# EasyEDA Pro project core_board.eprj

# Schematic SCH1

## Sheets
1 interface: Create Date: 2023-12-02; Page Name: interface; Project Name: core_board(8)(2); Schematic Name: SCH1; Update Date: 2023-12-17; Drawed: luq; Page Size: A4; Version: V1.0
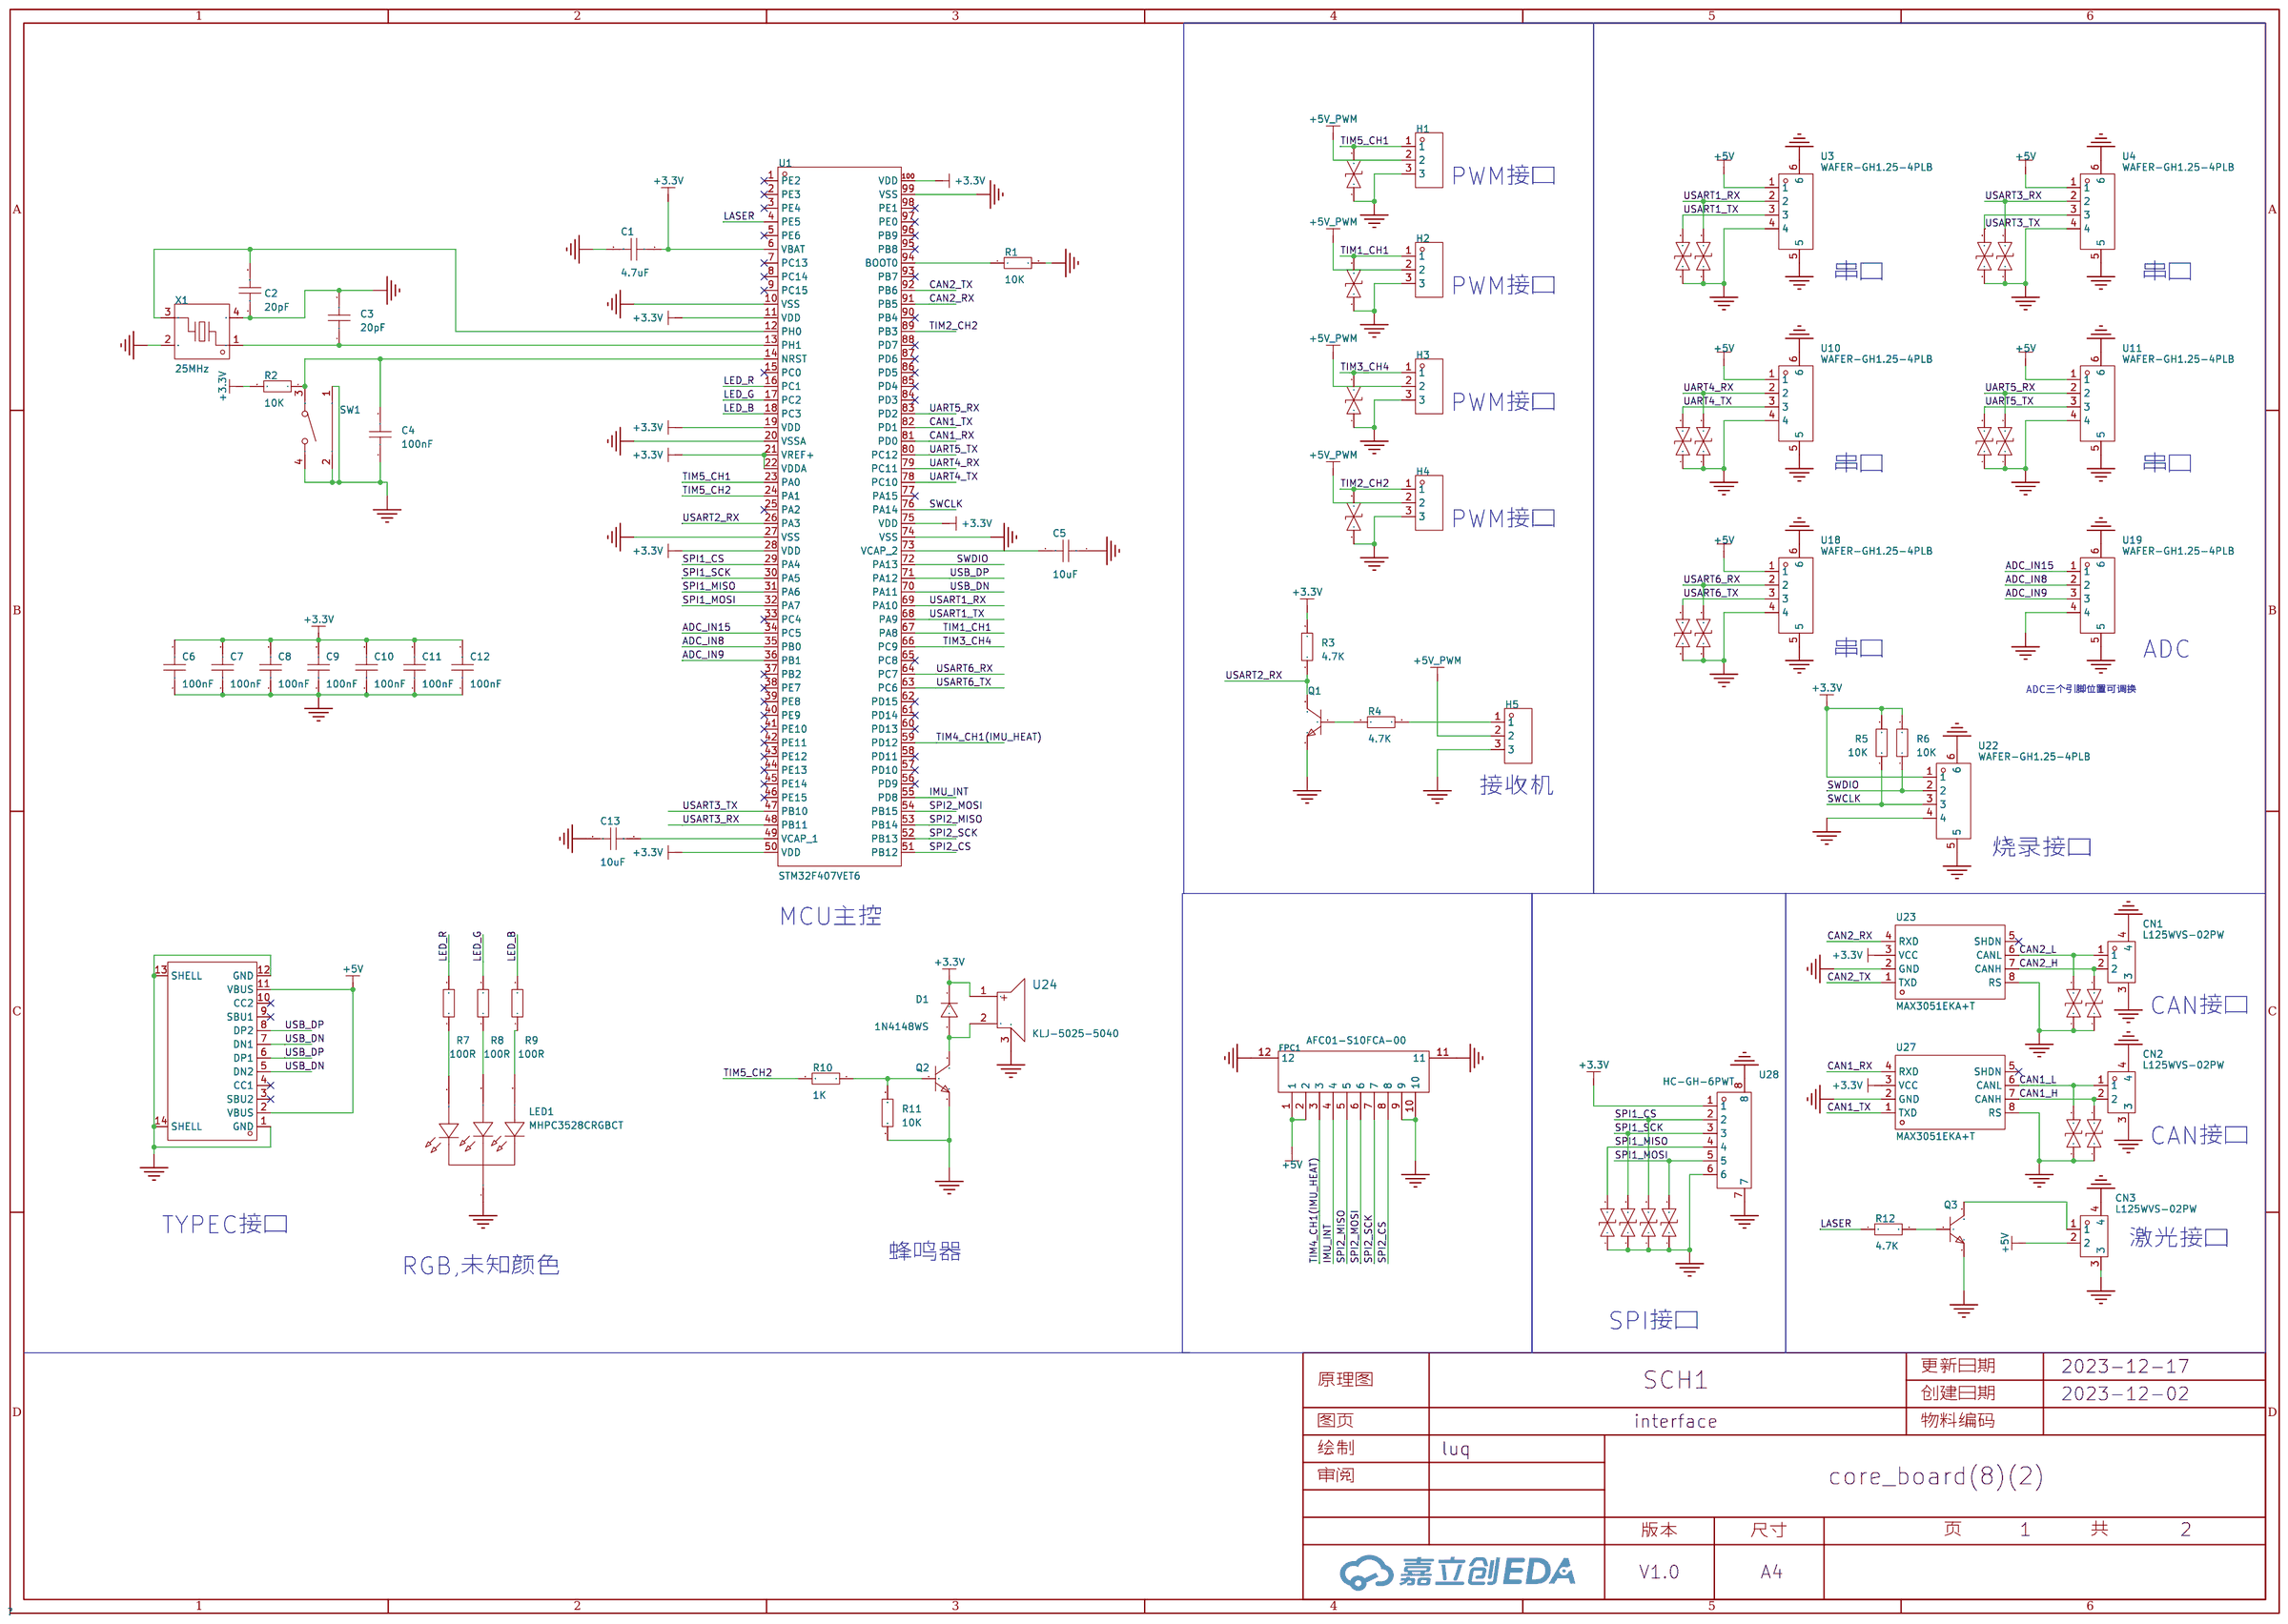
[diagram p0: interface]
2 power: Create Date: 2023-12-09; Page Name: power; Update Date: 2023-12-21
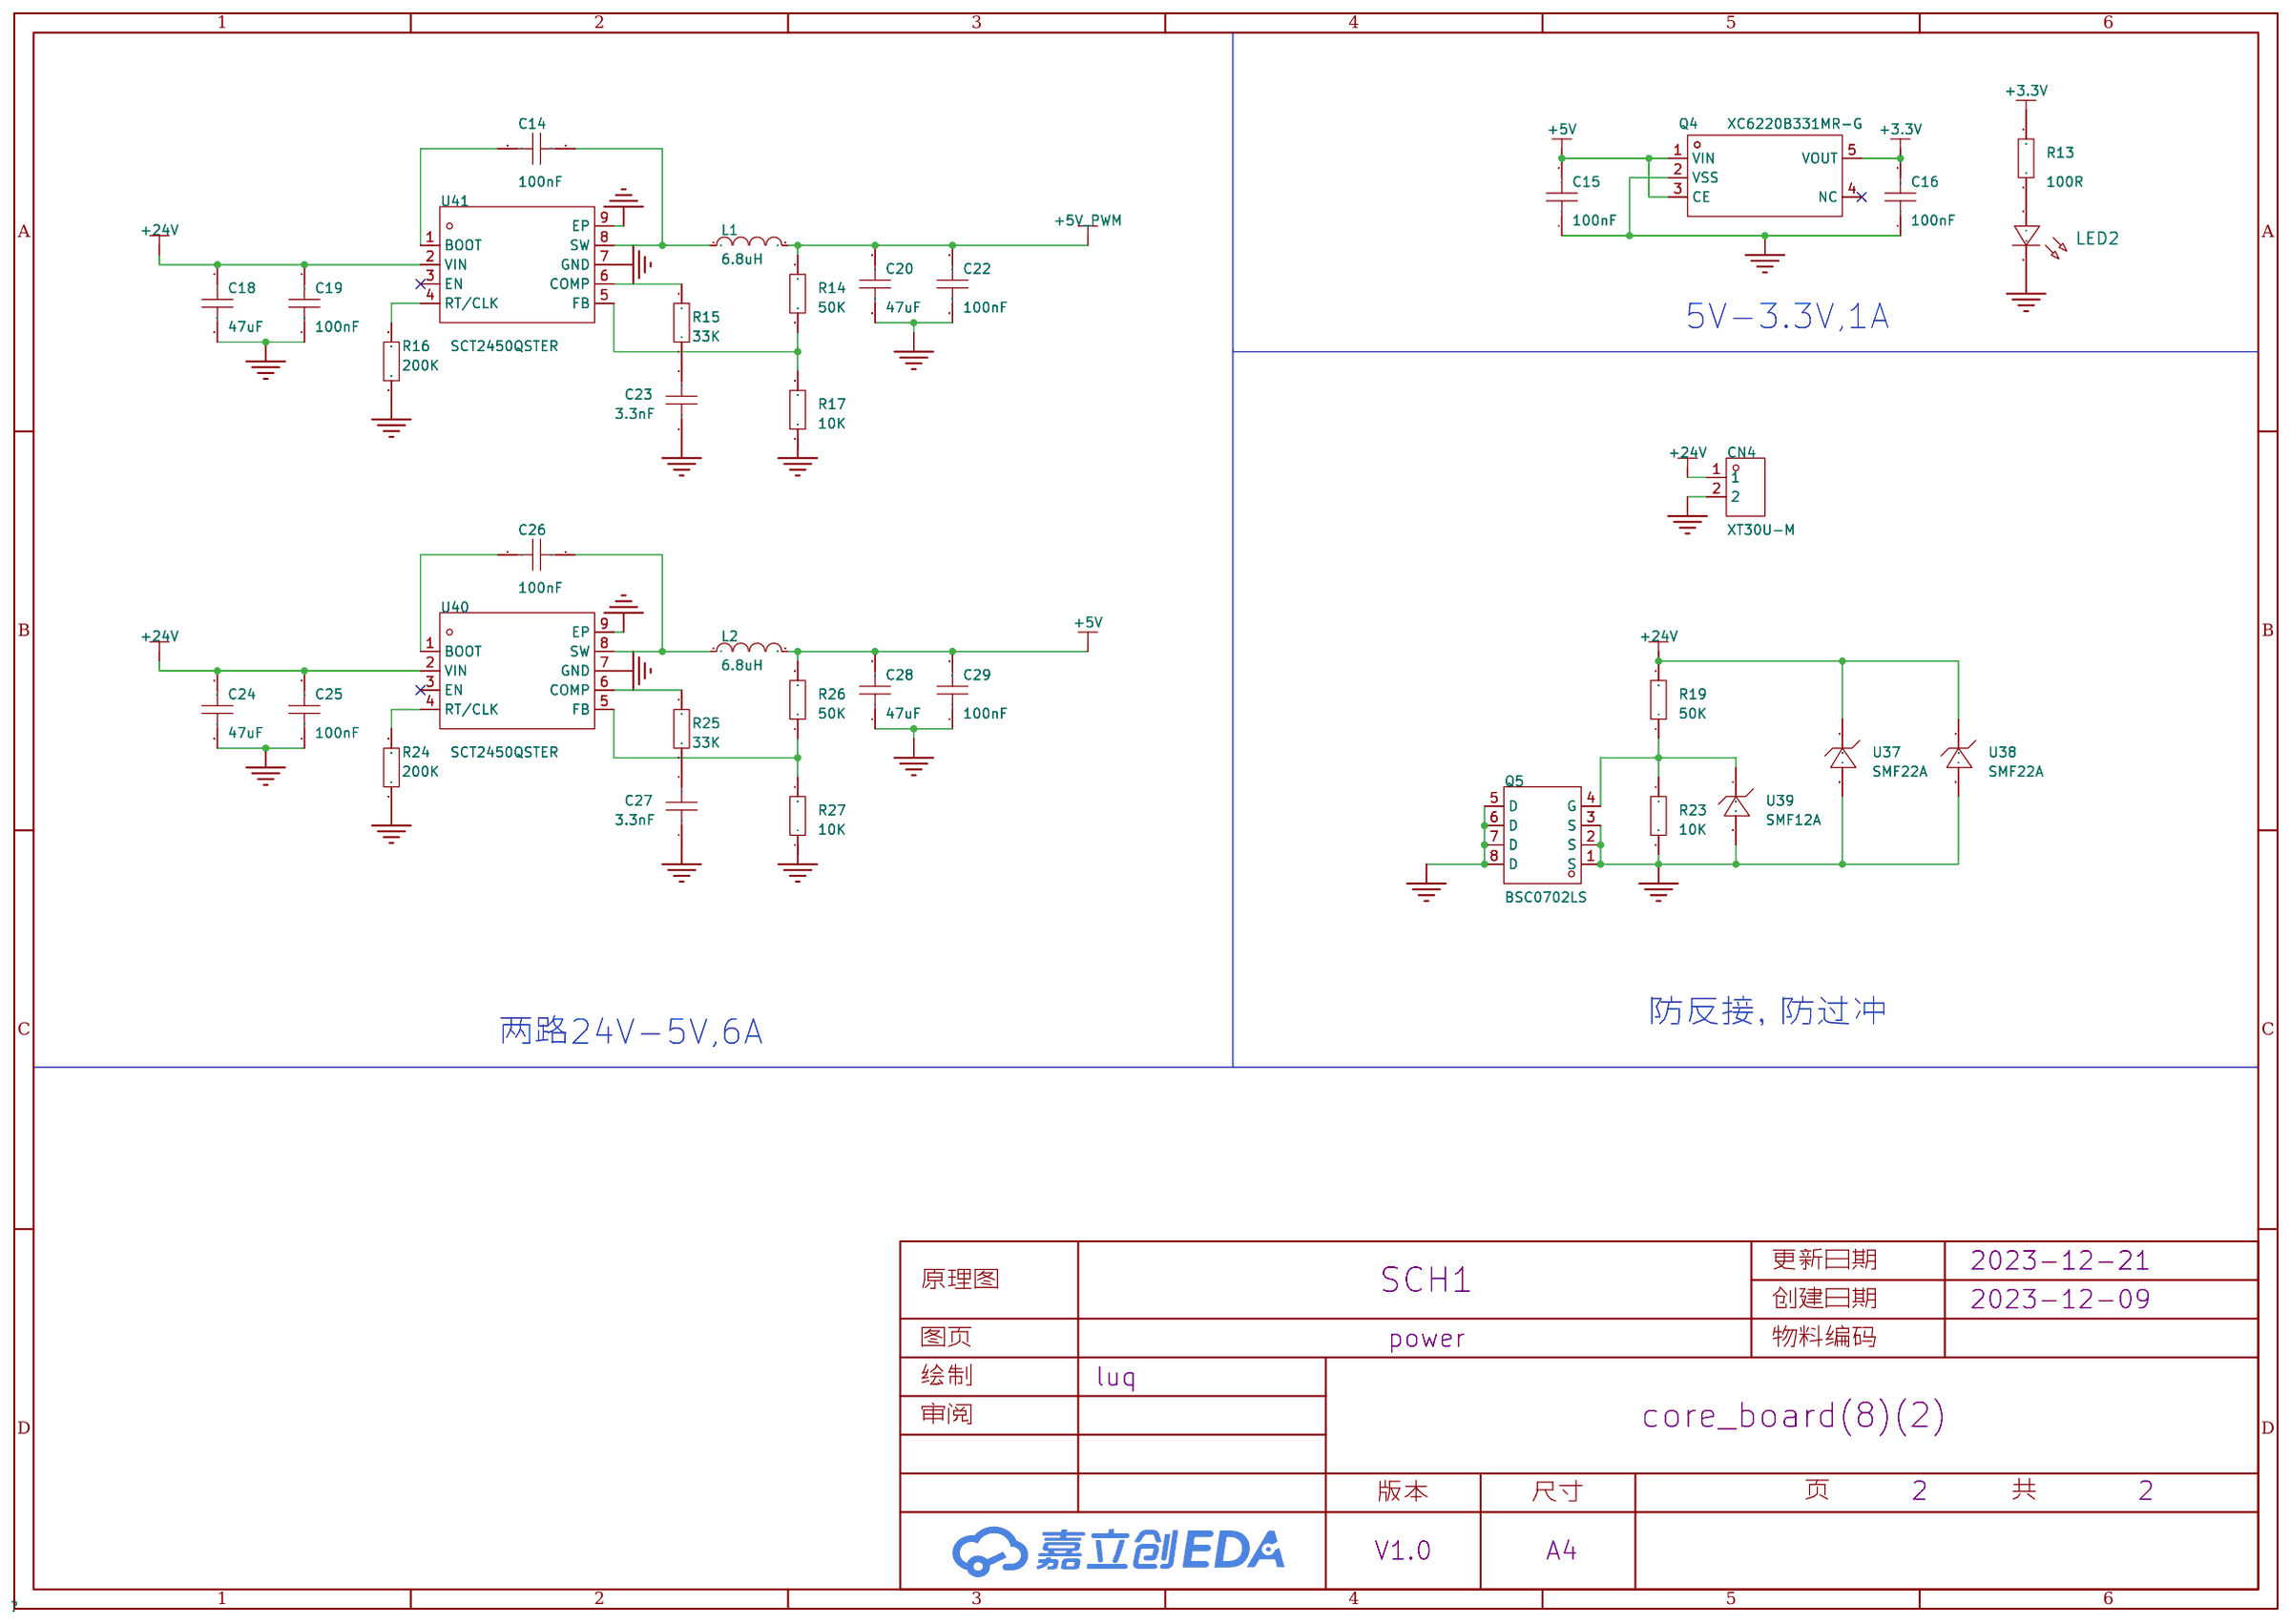
[diagram p1: power]

## Parts
sheet interface
C1  4.7uF  [C0402]
C2  20pF  [C0402]
C3  20pF  [C0402]
C4  100nF  [C0402]
C5  10uF  [C0402]
C6  100nF  [C0402]
C7  100nF  [C0402]
C8  100nF  [C0402]
C9  100nF  [C0402]
C10  100nF  [C0402]
C11  100nF  [C0402]
C12  100nF  [C0402]
C13  10uF  [C0402]
CN1  L125WVS-02PW  [CONN-SMD_2P-P1.25_DELON_L125WVS-02PW]
CN2  L125WVS-02PW  [CONN-SMD_2P-P1.25_DELON_L125WVS-02PW]
CN3  L125WVS-02PW  [CONN-SMD_2P-P1.25_DELON_L125WVS-02PW]
D1  1N4148WS  [SOD-323_L1.8-W1.3-LS2.5-RD]
FPC1  AFC01-S10FCA-00  [FPC-SMD_P0.5-10P_FGS-XJ-H2.0]
H1  -  [HDR-TH_3P-P2.54-V-M]
H2  -  [HDR-TH_3P-P2.54-V-M]
H3  -  [HDR-TH_3P-P2.54-V-M]
H4  -  [HDR-TH_3P-P2.54-V-M]
H5  -  [HDR-TH_3P-P2.54-V-M]
LED1  MHPC3528CRGBCT  [LED-SMD_4P-L3.2-W2.8-BL]
Q1  -  [S8050_SOT-23]
Q2  -  [S8050_SOT-23]
Q3  -  [S8050_SOT-23]
R1  10K  [R0402]
R2  10K  [R0402]
R3  4.7K  [R0603]
R4  4.7K  [R0603]
R5  10K  [R0603]
R6  10K  [R0603]
R7  100R  [R0402]
R8  100R  [R0402]
R9  100R  [R0402]
R10  1K  [R0603]
R11  10K  [R0603]
R12  4.7K  [R0603]
SW1  TS24CA  [SW-SMD_TS24CA]
U1  STM32F407VET6  [LQFP-100_L14.0-W14.0-P0.50-LS16.0-BL]
U2  PESD5V0F1BL  [SOD-882_L1.0-W0.6-BI]
U3  WAFER-GH1.25-4PLB  [CONN-SMD_4P-P1.25_XUNPU_WAFER-GH1.25-4PLB]
U4  WAFER-GH1.25-4PLB  [CONN-SMD_4P-P1.25_XUNPU_WAFER-GH1.25-4PLB]
U5  PESD5V0F1BL  [SOD-882_L1.0-W0.6-BI]
U6  PESD5V0F1BL  [SOD-882_L1.0-W0.6-BI]
U7  PESD5V0F1BL  [SOD-882_L1.0-W0.6-BI]
U8  PESD5V0F1BL  [SOD-882_L1.0-W0.6-BI]
U9  PESD5V0F1BL  [SOD-882_L1.0-W0.6-BI]
U10  WAFER-GH1.25-4PLB  [CONN-SMD_4P-P1.25_XUNPU_WAFER-GH1.25-4PLB]
U11  WAFER-GH1.25-4PLB  [CONN-SMD_4P-P1.25_XUNPU_WAFER-GH1.25-4PLB]
U12  PESD5V0F1BL  [SOD-882_L1.0-W0.6-BI]
U13  PESD5V0F1BL  [SOD-882_L1.0-W0.6-BI]
U14  PESD5V0F1BL  [SOD-882_L1.0-W0.6-BI]
U15  PESD5V0F1BL  [SOD-882_L1.0-W0.6-BI]
U16  PESD5V0F1BL  [SOD-882_L1.0-W0.6-BI]
U17  PESD5V0F1BL  [SOD-882_L1.0-W0.6-BI]
U18  WAFER-GH1.25-4PLB  [CONN-SMD_4P-P1.25_XUNPU_WAFER-GH1.25-4PLB]
U19  WAFER-GH1.25-4PLB  [CONN-SMD_4P-P1.25_XUNPU_WAFER-GH1.25-4PLB]
U20  PESD5V0F1BL  [SOD-882_L1.0-W0.6-BI]
U21  PESD5V0F1BL  [SOD-882_L1.0-W0.6-BI]
U22  WAFER-GH1.25-4PLB  [CONN-SMD_4P-P1.25_XUNPU_WAFER-GH1.25-4PLB]
U23  MAX3051EKA+T  [SOT-23-8_L3.0-W1.7-P0.65-LS2.8-TL]
U24  KLJ-5025-5040  [BUZ-SMD_3P-L5.0-W5.0-BL]
U25  PESD5V0F1BL  [SOD-882_L1.0-W0.6-BI]
U26  PESD5V0F1BL  [SOD-882_L1.0-W0.6-BI]
U27  MAX3051EKA+T  [SOT-23-8_L3.0-W1.7-P0.65-LS2.8-TL]
U28  HC-GH-6PWT  [CONN-SMD_6P-P1.25_HCTL_HC-GH-6PWT]
U29  PESD5V0F1BL  [SOD-882_L1.0-W0.6-BI]
U30  PESD5V0F1BL  [SOD-882_L1.0-W0.6-BI]
U31  PESD5V0F1BL  [SOD-882_L1.0-W0.6-BI]
U32  PESD5V0F1BL  [SOD-882_L1.0-W0.6-BI]
U33  PESD5V0F1BL  [SOD-882_L1.0-W0.6-BI]
U34  PESD5V0F1BL  [SOD-882_L1.0-W0.6-BI]
USB1  TYPE-C 16PIN 2MD(073)  [USB-C-SMD_TYPE-C-6PIN-2MD-073]
X1  25MHz  [CRYSTAL-SMD_4P-L3.2-W2.5-BL]
sheet power
C14  100nF  [C0603]
C15  100nF  [C0402]
C16  100nF  [C0402]
C18  47uF  [C1206]
C19  100nF  [C0603]
C20  47uF  [C1206]
C22  100nF  [C0603]
C23  3.3nF  [C0603]
C24  47uF  [C1206]
C25  100nF  [C0603]
C26  100nF  [C0603]
C27  3.3nF  [C0603]
C28  47uF  [C1206]
C29  100nF  [C0603]
CN4  XT30U-M  [CONN-TH_XT30U-M]
L1  6.8uH  [IND-SMD_L7.0-W6.6]
L2  6.8uH  [IND-SMD_L7.0-W6.6]
LED2  -  [LED_0603]
Q4  XC6220B331MR-G  [SOT-25_L3.0-W1.6-P0.95-LS2.8-TL]
Q5  BSC0702LS  [PG-TDSON-8_L5.0-W6.0-P1.27-BL-EP]
R13  100R  [R0402]
R14  50K  [R0603]
R15  33K  [R0603]
R16  200K  [R0603]
R17  10K  [R0603]
R19  50K  [R0402]
R23  10K  [R0402]
R24  200K  [R0603]
R25  33K  [R0603]
R26  50K  [R0603]
R27  10K  [R0603]
U37  SMF22A  [SOD-123FL_L2.8-W1.9-LS3.7-RD]
U38  SMF22A  [SOD-123FL_L2.8-W1.9-LS3.7-RD]
U39  SMF12A  [SOD-123FL_L2.7-W1.8-LS3.7-RD]
U40  SCT2450QSTER  [ESOP-8_L4.9-W3.9-P1.27-LS6.0-BL-EP]
U41  SCT2450QSTER  [ESOP-8_L4.9-W3.9-P1.27-LS6.0-BL-EP]

## Library data of the parts
C1-C16 C23 C26 C27 = CAP_0402: Supplier Footprint: 0402
CN1-CN3 = L125WVS-02PW: 插针结构:1x2P;间距:1.25mm;公母:公;安装方式:卧贴;排数:1;每排PIN数:2;额定电流:1A;工作温度范围:-40℃~+110℃;; LCSC Part Name: 1x2P 间距:1.25mm 卧贴 GH1.25间距卧式贴片 2P 连接器; Supplier Part: C2998790; Manufacturer: DEALON(德艺隆); Supplier Footprint: SMD,P=1.25mm; JLCPCB Part Class: 扩展库; Datasheet: https://atta.szlcsc.com/upload/public/pdf/source/20220425/50B09E6409C3A2782C6D65104D18E34A.pdf; Supplier: LCSC; Pins Structure: 1x2P; Pitch: 1.25mm; Gender: 公; Mounting Style: 卧贴; Number of Rows: 1; Number of PINs Per Row: 2; Current Rating (Max): 1A; Operating Temperature Range: -40℃~+110℃
D1 = 1N4148WS_C2128: 二极管配置:独立式;正向压降(Vf):1.25V@150mA;直流反向耐压(Vr):100V;平均整流电流(Io):150mA;功率:200mW;反向恢复时间(trr):4ns;; LCSC Part Name: 电压:100V 电流:150mA; Supplier Part: C2128; Manufacturer: CJ(江苏长电/长晶); Supplier Footprint: SOD-323; JLCPCB Part Class: Basic Part; Datasheet: https://atta.szlcsc.com/upload/public/pdf/source/20140809/1457707208178.pdf; Supplier: LCSC; Diode Configuration: 独立式; Forward Voltage (Vf@If): 1.25V@150mA; Reverse Voltage (Vr): 100V; Average Rectified Current (Io): 150mA; Power Dissipation: 200mW; Reverse Leakage Current: 1uA@75V; Reverse Recovery Time (trr): 4ns
FPC1 = AFC01-S10FCA-00: 间距:0.5mm;触点数量:10P;锁定特性:翻盖式;安装类型:卧贴;触点类型:下接;; LCSC Part Name: 0.5mm P数:10P 翻盖式 下接; Supplier Part: C262659; Manufacturer: JS(钜硕电子); Supplier Footprint: SMD,P=0.5mm; JLCPCB Part Class: 扩展库; Datasheet: https://atta.szlcsc.com/upload/public/pdf/source/20190816/C413942_2A72D1AC756EAE17EEDF756A339D4500.pdf; Supplier: LCSC; Pitch: 0.5mm; Number of Contacts: 10P; Locking Feature: 翻盖式; Mounting Type: 卧贴; Contact Type: 下接; Height Above Board: 2mm; FFC, FCB Thickness: 0.3mm
H1-H5 = HDR-M_2.54_1x3P: Supplier Part: C2937625; Supplier Footprint: 插件
LED1 = MHPC3528CRGBCT: 发光颜色:RGB三色;二极管配置:共阴极;功率:100mW；60mW；110mW;透镜颜色:无色透明透镜;主波长:621nm；520nm；465nm;色温:-;发光角度:120°;安装方式:正贴;工作温度:-40℃~+85℃;; LCSC Part Name: RGB三色 正贴; Supplier Part: C2962096; Manufacturer: MEIHUA(美华); Supplier Footprint: SMD3528; JLCPCB Part Class: 扩展库; Datasheet: https://atta.szlcsc.com/upload/public/pdf/source/20220214/73087548F13E6E0DCDC909BC417D1CBB.pdf; Supplier: LCSC; Emitted Color: RGB三色; Diode Configuration: 共阴极; Forward Current: 20mA; Power Dissipation: 100mW；60mW；110mW; Lens Color: 无色透明透镜; Dominant Wavelength: 621nm；520nm；465nm; Peak Wavelength: 460nm；630nm；515nm; Viewing Angle: 120°; Mounting Sytle: 正贴; Operating Temperature: -40℃~+85℃
Q1-Q3 = S8050_SOT_NPN: Supplier Footprint: SOT-23
R1 R2 R7-R9 R13-R17 R19 R23-R27 = Res_0402: Supplier Footprint: 0402
R3-R6 R10-R12 = Res_0603: Supplier Footprint: 0603
SW1 = TS24CA: 触点电流:50mA;额定电压(DC):12V;电路结构:单刀单掷;安装方式:卧贴;带灯:-;机械寿命:-;; LCSC Part Name: 4.55*1.8*3.5mm 卧贴 轻触开关; Supplier Part: C393942; Manufacturer: SHOU HAN(首韩); Supplier Footprint: SMD; JLCPCB Part Class: 扩展库; Datasheet: https://atta.szlcsc.com/upload/public/pdf/source/20190521/C393942_591A9E318887EFA4274D34029981AD99.pdf; Supplier: LCSC; Contact Current: 50mA; Voltage Rating (DC): 12V; Circuit: 单刀单掷; Mounting Style: 卧贴; Actuator Style: 矩形按钮; Switch Length: 4.55mm; Switch Width: 1.8mm; Switch Height: 3.5mm
U1 = STM32F407VGT6: CPU内核:ARM Cortex-M4;CPU最大主频:168MHz;工作电压范围:1.8V~3.6V;程序存储容量:1MB;程序存储器类型:FLASH;RAM总容量:192KB;GPIO端口数量:82;; Supplier Part: C12345; Manufacturer: ST(意法半导体); Supplier Footprint: LQFP-100(14x14); JLCPCB Part Class: 扩展库; Datasheet: https://atta.szlcsc.com/upload/public/pdf/source/20140801/1457707197138.pdf; Supplier: LCSC; CPU Core: ARM Cortex-M4; CPU Maximum Speed: 168MHz; Operating Voltage Range: 1.8V~3.6V; Program Storage Size: 1MB; Program Memory Type: FLASH; RAM Size: 192KB; GPIO Ports Number: 82; ADC (Bit): 12bit; DAC (Bit): 12bit; Universal Serial Bus: 有; Peripheral/Function: DMA；LCD/LED驱动; Watchdog: 有; Infrared Data Association: 有; Low-Voltage Detect: 有; LCD Module: 有; Direct Memory Access: 有; Internal Oscillator: 有; Operating Temperature Range: -40℃~+85℃
U2 U5-U9 U12-U17 U20 U21 U25 U26 U29-U34 = PESD5V0F1BL_C3001950: Supplier Part: C3001950; Manufacturer: UMW(友台半导体); Supplier Footprint: SOD-882; JLCPCB Part Class: 扩展库; Datasheet: https://atta.szlcsc.com/upload/public/pdf/source/20220425/FF8C97AEF8D545165C1993D730ADA9C6.pdf; Supplier: LCSC
U3 U4 U10 U11 U18 U19 U22 = WAFER-GH1.25-4PLB: 插针结构:1x4P;间距:1.25mm;公母:公;安装方式:立贴;排数:1;每排PIN数:4;参考系列:GH;额定电流:1A;工作温度范围:-25℃~+85℃;; LCSC Part Name: 1x4P 间距:1.25mm 立贴 系列:GH 带扣; Supplier Part: C3029370; Manufacturer: XUNPU(讯普); Supplier Footprint: SMD,P=1.25mm; JLCPCB Part Class: 扩展库; Datasheet: https://atta.szlcsc.com/upload/public/pdf/source/20220527/44F824AAC8C2B617205E15955FF9C23D.pdf; Supplier: LCSC; Pins Structure: 1x4P; Pitch: 1.25mm; Gender: 公; Mounting Style: 立贴; Number of Rows: 1; Number of PINs Per Row: 4; Reference Series: GH; Current Rating (Max): 1A; Operating Temperature Range: -25℃~+85℃
U23 U27 = MAX3051EKA+T: 类型:收发器;数据速率:1Mbps;; LCSC Part Name: 1Mbps 3.14V~3.47V; Supplier Part: C112005; Manufacturer: ADI(亚德诺); Supplier Footprint: SOT-23-8; JLCPCB Part Class: 扩展库; Datasheet: https://atta.szlcsc.com/upload/public/pdf/source/20171014/C112005_15079752662991037925.pdf; Supplier: LCSC; Type: 收发器; Data Rate: 1Mbps; Supply Voltage: 3.14V~3.47V
U24 = KLJ-5025-5040: LCSC Part Name: 贴片蜂鸣器; Supplier Part: C18186310; Manufacturer: KELIKING(凯丽金); Supplier Footprint: SMD; Datasheet: https://atta.szlcsc.com/upload/public/pdf/source/20230919/99F38C6C0DA9E35614CEECE84924472F.pdf; Supplier: LCSC
U28 = HC-GH-6PWT: 插针结构:1x6P;间距:1.25mm;公母:公;安装方式:卧贴;排数:1;每排PIN数:6;参考系列:GH;额定电流:1A;工作温度范围:-25℃~+85℃;; LCSC Part Name: 1x6P 间距:1.25mm 卧贴 系列:GH 卧式贴片带扣 镀锡 6P; Supplier Part: C3011948; Manufacturer: HCTL(华灿天禄); Supplier Footprint: SMD,P=1.25mm; JLCPCB Part Class: 扩展库; Datasheet: https://atta.szlcsc.com/upload/public/pdf/source/20210728/C2845397_2BAB5616F3DD52263F1EF5392BF0F2D4.pdf; Supplier: LCSC; Pins Structure: 1x6P; Pitch: 1.25mm; Gender: 公; Mounting Style: 卧贴; Number of Rows: 1; Number of PINs Per Row: 6; Reference Series: GH; Current Rating (Max): 1A; Operating Temperature Range: -25℃~+85℃
USB1 = TYPE-C 16PIN 2MD(073): 连接器类型:Type-C;标准:-;公母:母;触点数量:16P;端口数量:1;安装方式:卧贴;额定电流 - 电源:5A;工作温度范围:-25℃~+85℃;; LCSC Part Name: Type-C 母 卧贴 带定位柱 不锈钢外壳 2次模顶; Supplier Part: C2765186; Manufacturer: SHOU HAN(首韩); Supplier Footprint: SMD; JLCPCB Part Class: Extended Part; Datasheet: https://atta.szlcsc.com/upload/public/pdf/source/20211123/39B17C16241EAC15C5E277BDA434118E.pdf; Supplier: LCSC; Connector Type: Type-C; Gender: 母; Number of Contacts: 16P; Number of Ports: 1; Mounting Style: 卧贴; Current Rating - Power (Max): 5A; Operating Temperature Range: -25℃~+85℃
X1 = XL2EL89CSI-111YLC-25M: 频率:25MHz;负载电容:20pF;频率公差:±10ppm;; LCSC Part Name: 25MHz ±10ppm 20pF YSX321SL; Supplier Part: C5280577; Manufacturer: YXC(扬兴晶振); Supplier Footprint: SMD3225-4P; JLCPCB Part Class: 扩展库; Datasheet: https://atta.szlcsc.com/upload/public/pdf/source/20221123/8DAA01809C4E3F159850A71277C18D74.pdf; Supplier: LCSC; Crystal Type: 贴片无源晶振; Load Capacitance: 20pF; Frequency Tolerance: ±10ppm
C18 C24 = CAP_1206: Supplier Footprint: 1206
C19 C20 C22 C25 C28 C29 = CAP_0603: Supplier Footprint: 0603
CN4 = XT30U-M: 模型插头轻量版锂电池插头; LCSC Part Name: AMASS(艾迈斯)轻量版锂电池插头公头 XT30U-M; Supplier Part: C99101; Manufacturer: AMASS(艾迈斯); JLCPCB Part Class: 扩展库; Datasheet: https://atta.szlcsc.com/upload/public/pdf/source/20170606/1496716542582.pdf; Supplier: LCSC
L1 L2 = FXL0630-6R8-M: 电感值:6.8uH;精度:±20%;额定电流:5A;类型:一体成型电感;饱和电流(Isat):6A;; LCSC Part Name: 6.8uH ±20% 6A; Supplier Part: C167221; Manufacturer: cjiang(长江微电); Supplier Footprint: SMD,6.6x7mm; JLCPCB Part Class: Extended Part; Datasheet: https://atta.szlcsc.com/upload/public/pdf/source/20230516/3A080F5AF8C87BB81C3BA86E5F60E51A.pdf; Supplier: LCSC; Tolerance: ±20%; Rated Current: 5A; Type: 一体成型电感; DC Resistance (DCR): 48mΩ; Saturation Current (Isat): 6A
LED2 = LED_0603-R: Supplier Footprint: 0603
Q4 = XC6220B331MR-G: 输出类型:固定;输出极性:正;最大输入电压:6V;输出电压:3.3V;输出电流:1A;电源纹波抑制比(PSRR):50dB@(1kHz);; Supplier Part: C86534; Manufacturer: TOREX(特瑞仕); Supplier Footprint: SOT-25-5; JLCPCB Part Class: 扩展库; Datasheet: https://atta.szlcsc.com/upload/public/pdf/source/20161119/1479540186106.pdf; Supplier: LCSC; Output Type: 固定; Output Polarity: 正; Number of Outputs: 1; Maximum Input Voltage: 6V; Output Voltage: 3.3V; Dropout Voltage: 655mV@(1A); Output Current: 1A; Power Supply Rejection Ratio (PSRR): 50dB@(1kHz)
Q5 = BSC0702LS: 类型:N沟道;漏源电压(Vdss):60V;连续漏极电流(Id):100A;功率(Pd):83W;导通电阻(RDS(on)@Vgs,Id):2.3mΩ@10V,50A;; LCSC Part Name: N沟道 耐压:60V 电流:100A; Supplier Part: C501503; Manufacturer: Infineon(英飞凌); Supplier Footprint: TDSON-8-EP(5x6); JLCPCB Part Class: 扩展库; Datasheet: https://atta.szlcsc.com/upload/public/pdf/source/20200324/C501503_BE3C55BAEEDCAD77F3934BFEE5415F86.pdf; Supplier: LCSC; Type: N沟道; Drain Source Voltage (Vdss): 60V; Continuous Drain Current (Id): 100A; Power Dissipation (Pd): 83W; Drain Source On Resistance (RDS(on)@Vgs,Id): 2.3mΩ@10V,50A; Gate Threshold Voltage (Vgs(th)@Id): 2.3V@49uA
U37 U38 = SMF22A_C2943862: 反向截止电压(Vrwm):22V;最大钳位电压:35.5V;峰值脉冲电流(Ipp)@10/1000us:5.6A;击穿电压:24.4V;; Supplier Part: C2943862; Manufacturer: GOODWORK(固得沃克); Supplier Footprint: SOD-123FL; JLCPCB Part Class: 扩展库; Datasheet: https://atta.szlcsc.com/upload/public/pdf/source/20220524/AA0A0E50DAB96579C66583AA0A8CF024.pdf; Supplier: LCSC; Reverse Stand-Off Voltage (Vrwm): 22V; Maximum Clamping Voltage: 35.5V; Peak Pulse Current (Ipp)@10/1000us: 5.6A; Breakdown Voltage: 24.4V; Reverse Leakage Current (Ir): 1uA
U39 = SMF12A_C2943870: 反向截止电压(Vrwm):12V;最大钳位电压:19.9V;峰值脉冲电流(Ipp)@10/1000us:10.1A;击穿电压:13.3V;; Supplier Part: C2943870; Manufacturer: GOODWORK(固得沃克); Supplier Footprint: SOD-123FL; JLCPCB Part Class: 扩展库; Datasheet: https://atta.szlcsc.com/upload/public/pdf/source/20220524/AA0A0E50DAB96579C66583AA0A8CF024.pdf; Supplier: LCSC; Reverse Stand-Off Voltage (Vrwm): 12V; Maximum Clamping Voltage: 19.9V; Peak Pulse Current (Ipp)@10/1000us: 10.1A; Breakdown Voltage: 13.3V; Reverse Leakage Current (Ir): 2.5uA
U40 U41 = SCT2450QSTER: DCDC降压变换器; Supplier Part: C2929524; Manufacturer: SCT(芯洲科技); Supplier Footprint: ESOP-8; JLCPCB Part Class: Extended Part; Datasheet: https://atta.szlcsc.com/upload/public/pdf/source/20211215/931D8B56C9B2E8CCF51B671F286E63AF.pdf; Supplier: LCSC

## Nets
+3.3V: C1.1 C6.2 C7.2 C8.2 C9.2 C10.2 C11.2 C12.2 C16.2 D1.1(K) Q4.5(VOUT) R2.2 R3.2 R5.2 R6.2 R13.2 U1.6(VBAT) U1.11(VDD) U1.19(VDD) U1.21(VREF+) U1.22(VDDA) U1.28(VDD) U1.50(VDD) U1.75(VDD) U1.100(VDD) U22.1 U23.3(VCC) U24.1 U27.3(VCC) U28.1
+5V: C15.2 C28.2 C29.2 CN3.2 FPC1.1 FPC1.2 L2.2 Q4.1(VIN) Q4.3(CE) R26.2 U3.1 U4.1 U10.1 U11.1 U18.1 USB1.2(VBUS) USB1.11(VBUS)
+5V_PWM: C20.2 C22.2 H1.2 H2.2 H3.2 H4.2 H5.2 L1.2 R14.2
+24V: C18.1 C19.2 C24.1 C25.2 CN4.1 R19.2 U37.1(C) U38.1(C) U40.2(VIN) U41.2(VIN)
GND: C1.2 C2.1 C3.2 C4.1 C5.1 C6.1 C7.1 C8.1 C9.1 C10.1 C11.1 C12.1 C13.2 C15.1 C16.1 C18.2 C19.1 C20.1 C22.1 C23.1 C24.2 C25.1 C27.1 C28.1 C29.1 CN1.3 CN1.4 CN2.3 CN2.4 CN3.3 CN3.4 FPC1.9 FPC1.10 FPC1.11 FPC1.12 H1.3 H2.3 H3.3 H4.3 H5.3 LED1.4(-) LED2.1(C) Q1.2 Q2.2 Q3.2 Q4.2(VSS) Q5.1(S) Q5.2(S) Q5.3(S) R1.2 R11.1 R16.1 R17.1 R23.2 R24.1 R27.1 SW1.1 SW1.2 SW1.4 U1.10(VSS) U1.20(VSSA) U1.27(VSS) U1.74(VSS) U1.99(VSS) U2.1 U3.4 U3.5 U3.6 U4.4 U4.5 U4.6 U5.1 U6.1 U7.1 U8.1 U9.1 U10.4 U10.5 U10.6 U11.4 U11.5 U11.6 U12.1 U13.1 U14.1 U15.1 U16.1 U17.1 U18.4 U18.5 U18.6 U19.4 U19.5 U19.6 U20.1 U21.1 U22.4 U22.5 U22.6 U23.2(GND) U23.8(RS) U24.3 U25.1 U26.1 U27.2(GND) U27.8(RS) U28.6 U28.7 U28.8 U29.1 U30.1 U31.1 U32.1 U33.1 U34.1 U37.2(A) U38.2(A) U39.2(A) U40.7(GND) U40.9(EP) U41.7(GND) U41.9(EP) USB1.1(GND) USB1.12(GND) USB1.13(SHELL) USB1.14(SHELL) X1.2(GND) X1.4(GND)
PGND: CN4.2 Q5.5(D) Q5.6(D) Q5.7(D) Q5.8(D)
ADC_IN8: U1.35(PB0) U19.2
ADC_IN9: U1.36(PB1) U19.3
ADC_IN15: U1.34(PC5) U19.1
CAN1_H: CN2.2 U27.7(CANH) U30.2
CAN1_L: CN2.1 U27.6(CANL) U29.2
CAN1_RX: U1.81(PD0) U27.4(RXD)
CAN1_TX: U1.82(PD1) U27.1(TXD)
CAN2_H: CN1.2 U23.7(CANH) U26.2
CAN2_L: CN1.1 U23.6(CANL) U25.2
CAN2_RX: U1.91(PB5) U23.4(RXD)
CAN2_TX: U1.92(PB6) U23.1(TXD)
IMU_INT: FPC1.4 U1.55(PD8)
LASER: R12.1 U1.4(PE5)
LED_B: R9.2 U1.18(PC3)
LED_G: R8.2 U1.17(PC2)
LED_R: R7.2 U1.16(PC1)
SPI1_CS: U1.29(PA4) U28.2 U33.2
SPI1_MISO: U1.31(PA6) U28.4 U31.2
SPI1_MOSI: U1.32(PA7) U28.5 U34.2
SPI1_SCK: U1.30(PA5) U28.3 U32.2
SPI2_CS: FPC1.8 U1.51(PB12)
SPI2_MISO: FPC1.5 U1.53(PB14)
SPI2_MOSI: FPC1.6 U1.54(PB15)
SPI2_SCK: FPC1.7 U1.52(PB13)
SWCLK: R5.1 U1.76(PA14) U22.3
SWDIO: R6.1 U1.72(PA13) U22.2
TIM1_CH1: H2.1 U1.67(PA8) U9.2
TIM2_CH2: H4.1 U1.89(PB3) U17.2
TIM3_CH4: H3.1 U1.66(PC9) U12.2
TIM4_CH1(IMU_HEAT): FPC1.3 U1.59(PD12)
TIM5_CH1: H1.1 U1.23(PA0) U2.2
TIM5_CH2: R10.2 U1.24(PA1)
UART4_RX: U1.79(PC11) U10.2 U14.2
UART4_TX: U1.78(PC10) U10.3 U13.2
UART5_RX: U1.83(PD2) U11.2 U16.2
UART5_TX: U1.80(PC12) U11.3 U15.2
USART1_RX: U1.69(PA10) U3.2 U6.2
USART1_TX: U1.68(PA9) U3.3 U5.2
USART2_RX: Q1.3 R3.1 U1.26(PA3)
USART3_RX: U1.48(PB11) U4.2 U8.2
USART3_TX: U1.47(PB10) U4.3 U7.2
USART6_RX: U1.64(PC7) U18.2 U21.2
USART6_TX: U1.63(PC6) U18.3 U20.2
USB_DN: U1.70(PA11) USB1.5(DN2) USB1.7(DN1)
USB_DP: U1.71(PA12) USB1.6(DP1) USB1.8(DP2)
$C2_2: C2.2 U1.12(PH0) X1.3
$C3_1: C3.1 U1.13(PH1) X1.1
$C4_2: C4.2 R2.1 SW1.3 U1.14(NRST)
$C5_2: C5.2 U1.73(VCAP_2)
$C13_1: C13.1 U1.49(VCAP_1)
$C14_1: C14.1 U41.1(BOOT)
$C14_2: C14.2 L1.1 U41.8(SW)
$C23_2: C23.2 R15.1
$C26_1: C26.1 U40.1(BOOT)
$C26_2: C26.2 L2.1 U40.8(SW)
$C27_2: C27.2 R25.1
$CN3_1: CN3.1 Q3.3
$D1_2: D1.2(A) Q2.3 U24.2
$H5_1: H5.1 R4.2
$LED1_1: LED1.1(+) R7.1
$LED1_2: LED1.2(+) R8.1
$LED1_3: LED1.3(+) R9.1
$LED2_2: LED2.2(A) R13.1
$Q1_1: Q1.1 R4.1
$Q2_1: Q2.1 R10.1 R11.2
$Q3_1: Q3.1 R12.2
$Q5_4: Q5.4(G) R19.1 R23.1 U39.1(C)
$R1_1: R1.1 U1.94(BOOT0)
$R14_1: R14.1 R17.2 U41.5(FB)
$R15_2: R15.2 U41.6(COMP)
$R16_2: R16.2 U41.4(RT/CLK)
$R24_2: R24.2 U40.4(RT/CLK)
$R25_2: R25.2 U40.6(COMP)
$R26_1: R26.1 R27.2 U40.5(FB)

Not connected (* = marked no-connect by the designer): Q4 4(NC)*; U1 1(PE2)* 2(PE3)* 3(PE4)* 5(PE6)* 7(PC13)* 8(PC14)* 9(PC15)* 15(PC0)* 25(PA2)* 33(PC4)* 37(PB2)* 38(PE7)* 39(PE8)* 40(PE9)* 41(PE10)* 42(PE11)* 43(PE12)* 44(PE13)* 45(PE14)* 46(PE15)* 56(PD9)* 57(PD10)* 58(PD11)* 60(PD13)* 61(PD14)* 62(PD15)* 65(PC8)* 77(PA15)* 84(PD3)* 85(PD4)* 86(PD5)* 87(PD6)* 88(PD7)* 90(PB4)* 93(PB7)* 95(PB8)* 96(PB9)* 97(PE0)* 98(PE1)*; U23 5(SHDN)*; U27 5(SHDN)*; U40 3(EN)*; U41 3(EN)*; USB1 3(SBU2)* 4(CC1)* 9(SBU1)* 10(CC2)*

## Notes on the sheets
sheet 1
- PWM接口
- 串口
- 串口
- PWM接口
- PWM接口
- 串口
- 串口
- PWM接口
- 串口
- ADC
- ADC三个引脚位置可调换
- 接收机
- 烧录接口
- MCU主控
- CAN接口
- CAN接口
- TYPEC接口
- 蜂鸣器
- 激光接口
- RGB,未知颜色
- SPI接口
sheet 2
- 5V-3.3V,1A
- 防反接，防过冲
- 两路24V-5V,6A

# Board PCB1